# EAGLE board Resistor_Resistor (EAGLE 8.3.0), part 32 of 32
## Placement (x,y rotation side) (continued)
R39180  10K  [0201]  263.09,110.39 0 top
R39181  10K  [0201]  263.09,111 0 top
R39182  10K  [0201]  263.09,111.61 0 top
R39183  10K  [0201]  263.09,112.22 0 top
R39184  10K  [0201]  263.09,112.83 0 top
R39185  10K  [0201]  263.09,113.44 0 top
R39186  10K  [0201]  263.09,114.05 0 top
R39187  10K  [0201]  263.09,114.66 0 top
R39188  10K  [0201]  263.09,115.27 0 top
R39189  10K  [0201]  263.09,115.87 0 top
R39190  10K  [0201]  263.09,116.48 0 top
R39191  10K  [0201]  263.09,117.09 0 top
R39192  10K  [0201]  263.09,117.7 0 top
R39193  10K  [0201]  263.09,118.31 0 top
R39194  10K  [0201]  263.09,118.92 0 top
R39195  10K  [0201]  263.09,119.53 0 top
R39196  10K  [0201]  263.09,120.14 0 top
R39197  10K  [0201]  263.09,120.75 0 top
R39198  10K  [0201]  263.09,121.36 0 top
R39199  10K  [0201]  263.09,121.97 0 top
R39200  10K  [0201]  263.09,122.58 0 top
R39201  10K  [0201]  264.31,1.27 0 top
R39202  10K  [0201]  264.31,1.88 0 top
R39203  10K  [0201]  264.31,2.49 0 top
R39204  10K  [0201]  264.31,3.1 0 top
R39205  10K  [0201]  264.31,3.71 0 top
R39206  10K  [0201]  264.31,4.32 0 top
R39207  10K  [0201]  264.31,4.93 0 top
R39208  10K  [0201]  264.31,5.54 0 top
R39209  10K  [0201]  264.31,6.15 0 top
R39210  10K  [0201]  264.31,6.76 0 top
R39211  10K  [0201]  264.31,7.37 0 top
R39212  10K  [0201]  264.31,7.98 0 top
R39213  10K  [0201]  264.31,8.59 0 top
R39214  10K  [0201]  264.31,9.19 0 top
R39215  10K  [0201]  264.31,9.8 0 top
R39216  10K  [0201]  264.31,10.41 0 top
R39217  10K  [0201]  264.31,11.02 0 top
R39218  10K  [0201]  264.31,11.63 0 top
R39219  10K  [0201]  264.31,12.24 0 top
R39220  10K  [0201]  264.31,12.85 0 top
R39221  10K  [0201]  264.31,13.46 0 top
R39222  10K  [0201]  264.31,14.07 0 top
R39223  10K  [0201]  264.31,14.68 0 top
R39224  10K  [0201]  264.31,15.29 0 top
R39225  10K  [0201]  264.31,15.9 0 top
R39226  10K  [0201]  264.31,16.51 0 top
R39227  10K  [0201]  264.31,17.12 0 top
R39228  10K  [0201]  264.31,17.73 0 top
R39229  10K  [0201]  264.31,18.34 0 top
R39230  10K  [0201]  264.31,18.95 0 top
R39231  10K  [0201]  264.31,19.56 0 top
R39232  10K  [0201]  264.31,20.17 0 top
R39233  10K  [0201]  264.31,20.78 0 top
R39234  10K  [0201]  264.31,21.39 0 top
R39235  10K  [0201]  264.31,22 0 top
R39236  10K  [0201]  264.31,22.61 0 top
R39237  10K  [0201]  264.31,23.22 0 top
R39238  10K  [0201]  264.31,23.83 0 top
R39239  10K  [0201]  264.31,24.43 0 top
R39240  10K  [0201]  264.31,25.04 0 top
R39241  10K  [0201]  264.31,25.65 0 top
R39242  10K  [0201]  264.31,26.26 0 top
R39243  10K  [0201]  264.31,26.87 0 top
R39244  10K  [0201]  264.31,27.48 0 top
R39245  10K  [0201]  264.31,28.09 0 top
R39246  10K  [0201]  264.31,28.7 0 top
R39247  10K  [0201]  264.31,29.31 0 top
R39248  10K  [0201]  264.31,29.92 0 top
R39249  10K  [0201]  264.31,30.53 0 top
R39250  10K  [0201]  264.31,31.14 0 top
R39251  10K  [0201]  264.31,31.75 0 top
R39252  10K  [0201]  264.31,32.36 0 top
R39253  10K  [0201]  264.31,32.97 0 top
R39254  10K  [0201]  264.31,33.58 0 top
R39255  10K  [0201]  264.31,34.19 0 top
R39256  10K  [0201]  264.31,34.8 0 top
R39257  10K  [0201]  264.31,35.41 0 top
R39258  10K  [0201]  264.31,36.02 0 top
R39259  10K  [0201]  264.31,36.63 0 top
R39260  10K  [0201]  264.31,37.24 0 top
R39261  10K  [0201]  264.31,37.85 0 top
R39262  10K  [0201]  264.31,38.46 0 top
R39263  10K  [0201]  264.31,39.07 0 top
R39264  10K  [0201]  264.31,39.67 0 top
R39265  10K  [0201]  264.31,40.28 0 top
R39266  10K  [0201]  264.31,40.89 0 top
R39267  10K  [0201]  264.31,41.5 0 top
R39268  10K  [0201]  264.31,42.11 0 top
R39269  10K  [0201]  264.31,42.72 0 top
R39270  10K  [0201]  264.31,43.33 0 top
R39271  10K  [0201]  264.31,43.94 0 top
R39272  10K  [0201]  264.31,44.55 0 top
R39273  10K  [0201]  264.31,45.16 0 top
R39274  10K  [0201]  264.31,45.77 0 top
R39275  10K  [0201]  264.31,46.38 0 top
R39276  10K  [0201]  264.31,46.99 0 top
R39277  10K  [0201]  264.31,47.6 0 top
R39278  10K  [0201]  264.31,48.21 0 top
R39279  10K  [0201]  264.31,48.82 0 top
R39280  10K  [0201]  264.31,49.43 0 top
R39281  10K  [0201]  264.31,50.04 0 top
R39282  10K  [0201]  264.31,50.65 0 top
R39283  10K  [0201]  264.31,51.26 0 top
R39284  10K  [0201]  264.31,51.87 0 top
R39285  10K  [0201]  264.31,52.48 0 top
R39286  10K  [0201]  264.31,53.09 0 top
R39287  10K  [0201]  264.31,53.7 0 top
R39288  10K  [0201]  264.31,54.31 0 top
R39289  10K  [0201]  264.31,54.91 0 top
R39290  10K  [0201]  264.31,55.52 0 top
R39291  10K  [0201]  264.31,56.13 0 top
R39292  10K  [0201]  264.31,56.74 0 top
R39293  10K  [0201]  264.31,57.35 0 top
R39294  10K  [0201]  264.31,57.96 0 top
R39295  10K  [0201]  264.31,58.57 0 top
R39296  10K  [0201]  264.31,59.18 0 top
R39297  10K  [0201]  264.31,59.79 0 top
R39298  10K  [0201]  264.31,60.4 0 top
R39299  10K  [0201]  264.31,61.01 0 top
R39300  10K  [0201]  264.31,61.62 0 top
R39301  10K  [0201]  264.31,62.23 0 top
R39302  10K  [0201]  264.31,62.84 0 top
R39303  10K  [0201]  264.31,63.45 0 top
R39304  10K  [0201]  264.31,64.06 0 top
R39305  10K  [0201]  264.31,64.67 0 top
R39306  10K  [0201]  264.31,65.28 0 top
R39307  10K  [0201]  264.31,65.89 0 top
R39308  10K  [0201]  264.31,66.5 0 top
R39309  10K  [0201]  264.31,67.11 0 top
R39310  10K  [0201]  264.31,67.72 0 top
R39311  10K  [0201]  264.31,68.33 0 top
R39312  10K  [0201]  264.31,68.94 0 top
R39313  10K  [0201]  264.31,69.55 0 top
R39314  10K  [0201]  264.31,70.15 0 top
R39315  10K  [0201]  264.31,70.76 0 top
R39316  10K  [0201]  264.31,71.37 0 top
R39317  10K  [0201]  264.31,71.98 0 top
R39318  10K  [0201]  264.31,72.59 0 top
R39319  10K  [0201]  264.31,73.2 0 top
R39320  10K  [0201]  264.31,73.81 0 top
R39321  10K  [0201]  264.31,74.42 0 top
R39322  10K  [0201]  264.31,75.03 0 top
R39323  10K  [0201]  264.31,75.64 0 top
R39324  10K  [0201]  264.31,76.25 0 top
R39325  10K  [0201]  264.31,76.86 0 top
R39326  10K  [0201]  264.31,77.47 0 top
R39327  10K  [0201]  264.31,78.08 0 top
R39328  10K  [0201]  264.31,78.69 0 top
R39329  10K  [0201]  264.31,79.3 0 top
R39330  10K  [0201]  264.31,79.91 0 top
R39331  10K  [0201]  264.31,80.52 0 top
R39332  10K  [0201]  264.31,81.13 0 top
R39333  10K  [0201]  264.31,81.74 0 top
R39334  10K  [0201]  264.31,82.35 0 top
R39335  10K  [0201]  264.31,82.96 0 top
R39336  10K  [0201]  264.31,83.57 0 top
R39337  10K  [0201]  264.31,84.18 0 top
R39338  10K  [0201]  264.31,84.79 0 top
R39339  10K  [0201]  264.31,85.39 0 top
R39340  10K  [0201]  264.31,86 0 top
R39341  10K  [0201]  264.31,86.61 0 top
R39342  10K  [0201]  264.31,87.22 0 top
R39343  10K  [0201]  264.31,87.83 0 top
R39344  10K  [0201]  264.31,88.44 0 top
R39345  10K  [0201]  264.31,89.05 0 top
R39346  10K  [0201]  264.31,89.66 0 top
R39347  10K  [0201]  264.31,90.27 0 top
R39348  10K  [0201]  264.31,90.88 0 top
R39349  10K  [0201]  264.31,91.49 0 top
R39350  10K  [0201]  264.31,92.1 0 top
R39351  10K  [0201]  264.31,92.71 0 top
R39352  10K  [0201]  264.31,93.32 0 top
R39353  10K  [0201]  264.31,93.93 0 top
R39354  10K  [0201]  264.31,94.54 0 top
R39355  10K  [0201]  264.31,95.15 0 top
R39356  10K  [0201]  264.31,95.76 0 top
R39357  10K  [0201]  264.31,96.37 0 top
R39358  10K  [0201]  264.31,96.98 0 top
R39359  10K  [0201]  264.31,97.59 0 top
R39360  10K  [0201]  264.31,98.2 0 top
R39361  10K  [0201]  264.31,98.81 0 top
R39362  10K  [0201]  264.31,99.42 0 top
R39363  10K  [0201]  264.31,100.03 0 top
R39364  10K  [0201]  264.31,100.63 0 top
R39365  10K  [0201]  264.31,101.24 0 top
R39366  10K  [0201]  264.31,101.85 0 top
R39367  10K  [0201]  264.31,102.46 0 top
R39368  10K  [0201]  264.31,103.07 0 top
R39369  10K  [0201]  264.31,103.68 0 top
R39370  10K  [0201]  264.31,104.29 0 top
R39371  10K  [0201]  264.31,104.9 0 top
R39372  10K  [0201]  264.31,105.51 0 top
R39373  10K  [0201]  264.31,106.12 0 top
R39374  10K  [0201]  264.31,106.73 0 top
R39375  10K  [0201]  264.31,107.34 0 top
R39376  10K  [0201]  264.31,107.95 0 top
R39377  10K  [0201]  264.31,108.56 0 top
R39378  10K  [0201]  264.31,109.17 0 top
R39379  10K  [0201]  264.31,109.78 0 top
R39380  10K  [0201]  264.31,110.39 0 top
R39381  10K  [0201]  264.31,111 0 top
R39382  10K  [0201]  264.31,111.61 0 top
R39383  10K  [0201]  264.31,112.22 0 top
R39384  10K  [0201]  264.31,112.83 0 top
R39385  10K  [0201]  264.31,113.44 0 top
R39386  10K  [0201]  264.31,114.05 0 top
R39387  10K  [0201]  264.31,114.66 0 top
R39388  10K  [0201]  264.31,115.27 0 top
R39389  10K  [0201]  264.31,115.87 0 top
R39390  10K  [0201]  264.31,116.48 0 top
R39391  10K  [0201]  264.31,117.09 0 top
R39392  10K  [0201]  264.31,117.7 0 top
R39393  10K  [0201]  264.31,118.31 0 top
R39394  10K  [0201]  264.31,118.92 0 top
R39395  10K  [0201]  264.31,119.53 0 top
R39396  10K  [0201]  264.31,120.14 0 top
R39397  10K  [0201]  264.31,120.75 0 top
R39398  10K  [0201]  264.31,121.36 0 top
R39399  10K  [0201]  264.31,121.97 0 top
R39400  10K  [0201]  264.31,122.58 0 top
R39401  10K  [0201]  265.53,1.27 0 top
R39402  10K  [0201]  265.53,1.88 0 top
R39403  10K  [0201]  265.53,2.49 0 top
R39404  10K  [0201]  265.53,3.1 0 top
R39405  10K  [0201]  265.53,3.71 0 top
R39406  10K  [0201]  265.53,4.32 0 top
R39407  10K  [0201]  265.53,4.93 0 top
R39408  10K  [0201]  265.53,5.54 0 top
R39409  10K  [0201]  265.53,6.15 0 top
R39410  10K  [0201]  265.53,6.76 0 top
R39411  10K  [0201]  265.53,7.37 0 top
R39412  10K  [0201]  265.53,7.98 0 top
R39413  10K  [0201]  265.53,8.59 0 top
R39414  10K  [0201]  265.53,9.19 0 top
R39415  10K  [0201]  265.53,9.8 0 top
R39416  10K  [0201]  265.53,10.41 0 top
R39417  10K  [0201]  265.53,11.02 0 top
R39418  10K  [0201]  265.53,11.63 0 top
R39419  10K  [0201]  265.53,12.24 0 top
R39420  10K  [0201]  265.53,12.85 0 top
R39421  10K  [0201]  265.53,13.46 0 top
R39422  10K  [0201]  265.53,14.07 0 top
R39423  10K  [0201]  265.53,14.68 0 top
R39424  10K  [0201]  265.53,15.29 0 top
R39425  10K  [0201]  265.53,15.9 0 top
R39426  10K  [0201]  265.53,16.51 0 top
R39427  10K  [0201]  265.53,17.12 0 top
R39428  10K  [0201]  265.53,17.73 0 top
R39429  10K  [0201]  265.53,18.34 0 top
R39430  10K  [0201]  265.53,18.95 0 top
R39431  10K  [0201]  265.53,19.56 0 top
R39432  10K  [0201]  265.53,20.17 0 top
R39433  10K  [0201]  265.53,20.78 0 top
R39434  10K  [0201]  265.53,21.39 0 top
R39435  10K  [0201]  265.53,22 0 top
R39436  10K  [0201]  265.53,22.61 0 top
R39437  10K  [0201]  265.53,23.22 0 top
R39438  10K  [0201]  265.53,23.83 0 top
R39439  10K  [0201]  265.53,24.43 0 top
R39440  10K  [0201]  265.53,25.04 0 top
R39441  10K  [0201]  265.53,25.65 0 top
R39442  10K  [0201]  265.53,26.26 0 top
R39443  10K  [0201]  265.53,26.87 0 top
R39444  10K  [0201]  265.53,27.48 0 top
R39445  10K  [0201]  265.53,28.09 0 top
R39446  10K  [0201]  265.53,28.7 0 top
R39447  10K  [0201]  265.53,29.31 0 top
R39448  10K  [0201]  265.53,29.92 0 top
R39449  10K  [0201]  265.53,30.53 0 top
R39450  10K  [0201]  265.53,31.14 0 top
R39451  10K  [0201]  265.53,31.75 0 top
R39452  10K  [0201]  265.53,32.36 0 top
R39453  10K  [0201]  265.53,32.97 0 top
R39454  10K  [0201]  265.53,33.58 0 top
R39455  10K  [0201]  265.53,34.19 0 top
R39456  10K  [0201]  265.53,34.8 0 top
R39457  10K  [0201]  265.53,35.41 0 top
R39458  10K  [0201]  265.53,36.02 0 top
R39459  10K  [0201]  265.53,36.63 0 top
R39460  10K  [0201]  265.53,37.24 0 top
R39461  10K  [0201]  265.53,37.85 0 top
R39462  10K  [0201]  265.53,38.46 0 top
R39463  10K  [0201]  265.53,39.07 0 top
R39464  10K  [0201]  265.53,39.67 0 top
R39465  10K  [0201]  265.53,40.28 0 top
R39466  10K  [0201]  265.53,40.89 0 top
R39467  10K  [0201]  265.53,41.5 0 top
R39468  10K  [0201]  265.53,42.11 0 top
R39469  10K  [0201]  265.53,42.72 0 top
R39470  10K  [0201]  265.53,43.33 0 top
R39471  10K  [0201]  265.53,43.94 0 top
R39472  10K  [0201]  265.53,44.55 0 top
R39473  10K  [0201]  265.53,45.16 0 top
R39474  10K  [0201]  265.53,45.77 0 top
R39475  10K  [0201]  265.53,46.38 0 top
R39476  10K  [0201]  265.53,46.99 0 top
R39477  10K  [0201]  265.53,47.6 0 top
R39478  10K  [0201]  265.53,48.21 0 top
R39479  10K  [0201]  265.53,48.82 0 top
R39480  10K  [0201]  265.53,49.43 0 top
R39481  10K  [0201]  265.53,50.04 0 top
R39482  10K  [0201]  265.53,50.65 0 top
R39483  10K  [0201]  265.53,51.26 0 top
R39484  10K  [0201]  265.53,51.87 0 top
R39485  10K  [0201]  265.53,52.48 0 top
R39486  10K  [0201]  265.53,53.09 0 top
R39487  10K  [0201]  265.53,53.7 0 top
R39488  10K  [0201]  265.53,54.31 0 top
R39489  10K  [0201]  265.53,54.91 0 top
R39490  10K  [0201]  265.53,55.52 0 top
R39491  10K  [0201]  265.53,56.13 0 top
R39492  10K  [0201]  265.53,56.74 0 top
R39493  10K  [0201]  265.53,57.35 0 top
R39494  10K  [0201]  265.53,57.96 0 top
R39495  10K  [0201]  265.53,58.57 0 top
R39496  10K  [0201]  265.53,59.18 0 top
R39497  10K  [0201]  265.53,59.79 0 top
R39498  10K  [0201]  265.53,60.4 0 top
R39499  10K  [0201]  265.53,61.01 0 top
R39500  10K  [0201]  265.53,61.62 0 top
R39501  10K  [0201]  265.53,62.23 0 top
R39502  10K  [0201]  265.53,62.84 0 top
R39503  10K  [0201]  265.53,63.45 0 top
R39504  10K  [0201]  265.53,64.06 0 top
R39505  10K  [0201]  265.53,64.67 0 top
R39506  10K  [0201]  265.53,65.28 0 top
R39507  10K  [0201]  265.53,65.89 0 top
R39508  10K  [0201]  265.53,66.5 0 top
R39509  10K  [0201]  265.53,67.11 0 top
R39510  10K  [0201]  265.53,67.72 0 top
R39511  10K  [0201]  265.53,68.33 0 top
R39512  10K  [0201]  265.53,68.94 0 top
R39513  10K  [0201]  265.53,69.55 0 top
R39514  10K  [0201]  265.53,70.15 0 top
R39515  10K  [0201]  265.53,70.76 0 top
R39516  10K  [0201]  265.53,71.37 0 top
R39517  10K  [0201]  265.53,71.98 0 top
R39518  10K  [0201]  265.53,72.59 0 top
R39519  10K  [0201]  265.53,73.2 0 top
R39520  10K  [0201]  265.53,73.81 0 top
R39521  10K  [0201]  265.53,74.42 0 top
R39522  10K  [0201]  265.53,75.03 0 top
R39523  10K  [0201]  265.53,75.64 0 top
R39524  10K  [0201]  265.53,76.25 0 top
R39525  10K  [0201]  265.53,76.86 0 top
R39526  10K  [0201]  265.53,77.47 0 top
R39527  10K  [0201]  265.53,78.08 0 top
R39528  10K  [0201]  265.53,78.69 0 top
R39529  10K  [0201]  265.53,79.3 0 top
R39530  10K  [0201]  265.53,79.91 0 top
R39531  10K  [0201]  265.53,80.52 0 top
R39532  10K  [0201]  265.53,81.13 0 top
R39533  10K  [0201]  265.53,81.74 0 top
R39534  10K  [0201]  265.53,82.35 0 top
R39535  10K  [0201]  265.53,82.96 0 top
R39536  10K  [0201]  265.53,83.57 0 top
R39537  10K  [0201]  265.53,84.18 0 top
R39538  10K  [0201]  265.53,84.79 0 top
R39539  10K  [0201]  265.53,85.39 0 top
R39540  10K  [0201]  265.53,86 0 top
R39541  10K  [0201]  265.53,86.61 0 top
R39542  10K  [0201]  265.53,87.22 0 top
R39543  10K  [0201]  265.53,87.83 0 top
R39544  10K  [0201]  265.53,88.44 0 top
R39545  10K  [0201]  265.53,89.05 0 top
R39546  10K  [0201]  265.53,89.66 0 top
R39547  10K  [0201]  265.53,90.27 0 top
R39548  10K  [0201]  265.53,90.88 0 top
R39549  10K  [0201]  265.53,91.49 0 top
R39550  10K  [0201]  265.53,92.1 0 top
R39551  10K  [0201]  265.53,92.71 0 top
R39552  10K  [0201]  265.53,93.32 0 top
R39553  10K  [0201]  265.53,93.93 0 top
R39554  10K  [0201]  265.53,94.54 0 top
R39555  10K  [0201]  265.53,95.15 0 top
R39556  10K  [0201]  265.53,95.76 0 top
R39557  10K  [0201]  265.53,96.37 0 top
R39558  10K  [0201]  265.53,96.98 0 top
R39559  10K  [0201]  265.53,97.59 0 top
R39560  10K  [0201]  265.53,98.2 0 top
R39561  10K  [0201]  265.53,98.81 0 top
R39562  10K  [0201]  265.53,99.42 0 top
R39563  10K  [0201]  265.53,100.03 0 top
R39564  10K  [0201]  265.53,100.63 0 top
R39565  10K  [0201]  265.53,101.24 0 top
R39566  10K  [0201]  265.53,101.85 0 top
R39567  10K  [0201]  265.53,102.46 0 top
R39568  10K  [0201]  265.53,103.07 0 top
R39569  10K  [0201]  265.53,103.68 0 top
R39570  10K  [0201]  265.53,104.29 0 top
R39571  10K  [0201]  265.53,104.9 0 top
R39572  10K  [0201]  265.53,105.51 0 top
R39573  10K  [0201]  265.53,106.12 0 top
R39574  10K  [0201]  265.53,106.73 0 top
R39575  10K  [0201]  265.53,107.34 0 top
R39576  10K  [0201]  265.53,107.95 0 top
R39577  10K  [0201]  265.53,108.56 0 top
R39578  10K  [0201]  265.53,109.17 0 top
R39579  10K  [0201]  265.53,109.78 0 top
R39580  10K  [0201]  265.53,110.39 0 top
R39581  10K  [0201]  265.53,111 0 top
R39582  10K  [0201]  265.53,111.61 0 top
R39583  10K  [0201]  265.53,112.22 0 top
R39584  10K  [0201]  265.53,112.83 0 top
R39585  10K  [0201]  265.53,113.44 0 top
R39586  10K  [0201]  265.53,114.05 0 top
R39587  10K  [0201]  265.53,114.66 0 top
R39588  10K  [0201]  265.53,115.27 0 top
R39589  10K  [0201]  265.53,115.87 0 top
R39590  10K  [0201]  265.53,116.48 0 top
R39591  10K  [0201]  265.53,117.09 0 top
R39592  10K  [0201]  265.53,117.7 0 top
R39593  10K  [0201]  265.53,118.31 0 top
R39594  10K  [0201]  265.53,118.92 0 top
R39595  10K  [0201]  265.53,119.53 0 top
R39596  10K  [0201]  265.53,120.14 0 top
R39597  10K  [0201]  265.53,120.75 0 top
R39598  10K  [0201]  265.53,121.36 0 top
R39599  10K  [0201]  265.53,121.97 0 top
R39600  10K  [0201]  265.53,122.58 0 top
R39601  10K  [0201]  266.75,1.27 0 top
R39602  10K  [0201]  266.75,1.88 0 top
R39603  10K  [0201]  266.75,2.49 0 top
R39604  10K  [0201]  266.75,3.1 0 top
R39605  10K  [0201]  266.75,3.71 0 top
R39606  10K  [0201]  266.75,4.32 0 top
R39607  10K  [0201]  266.75,4.93 0 top
R39608  10K  [0201]  266.75,5.54 0 top
R39609  10K  [0201]  266.75,6.15 0 top
R39610  10K  [0201]  266.75,6.76 0 top
R39611  10K  [0201]  266.75,7.37 0 top
R39612  10K  [0201]  266.75,7.98 0 top
R39613  10K  [0201]  266.75,8.59 0 top
R39614  10K  [0201]  266.75,9.19 0 top
R39615  10K  [0201]  266.75,9.8 0 top
R39616  10K  [0201]  266.75,10.41 0 top
R39617  10K  [0201]  266.75,11.02 0 top
R39618  10K  [0201]  266.75,11.63 0 top
R39619  10K  [0201]  266.75,12.24 0 top
R39620  10K  [0201]  266.75,12.85 0 top
R39621  10K  [0201]  266.75,13.46 0 top
R39622  10K  [0201]  266.75,14.07 0 top
R39623  10K  [0201]  266.75,14.68 0 top
R39624  10K  [0201]  266.75,15.29 0 top
R39625  10K  [0201]  266.75,15.9 0 top
R39626  10K  [0201]  266.75,16.51 0 top
R39627  10K  [0201]  266.75,17.12 0 top
R39628  10K  [0201]  266.75,17.73 0 top
R39629  10K  [0201]  266.75,18.34 0 top
R39630  10K  [0201]  266.75,18.95 0 top
R39631  10K  [0201]  266.75,19.56 0 top
R39632  10K  [0201]  266.75,20.17 0 top
R39633  10K  [0201]  266.75,20.78 0 top
R39634  10K  [0201]  266.75,21.39 0 top
R39635  10K  [0201]  266.75,22 0 top
R39636  10K  [0201]  266.75,22.61 0 top
R39637  10K  [0201]  266.75,23.22 0 top
R39638  10K  [0201]  266.75,23.83 0 top
R39639  10K  [0201]  266.75,24.43 0 top
R39640  10K  [0201]  266.75,25.04 0 top
R39641  10K  [0201]  266.75,25.65 0 top
R39642  10K  [0201]  266.75,26.26 0 top
R39643  10K  [0201]  266.75,26.87 0 top
R39644  10K  [0201]  266.75,27.48 0 top
R39645  10K  [0201]  266.75,28.09 0 top
R39646  10K  [0201]  266.75,28.7 0 top
R39647  10K  [0201]  266.75,29.31 0 top
R39648  10K  [0201]  266.75,29.92 0 top
R39649  10K  [0201]  266.75,30.53 0 top
R39650  10K  [0201]  266.75,31.14 0 top
R39651  10K  [0201]  266.75,31.75 0 top
R39652  10K  [0201]  266.75,32.36 0 top
R39653  10K  [0201]  266.75,32.97 0 top
R39654  10K  [0201]  266.75,33.58 0 top
R39655  10K  [0201]  266.75,34.19 0 top
R39656  10K  [0201]  266.75,34.8 0 top
R39657  10K  [0201]  266.75,35.41 0 top
R39658  10K  [0201]  266.75,36.02 0 top
R39659  10K  [0201]  266.75,36.63 0 top
R39660  10K  [0201]  266.75,37.24 0 top
R39661  10K  [0201]  266.75,37.85 0 top
R39662  10K  [0201]  266.75,38.46 0 top
R39663  10K  [0201]  266.75,39.07 0 top
R39664  10K  [0201]  266.75,39.67 0 top
R39665  10K  [0201]  266.75,40.28 0 top
R39666  10K  [0201]  266.75,40.89 0 top
R39667  10K  [0201]  266.75,41.5 0 top
R39668  10K  [0201]  266.75,42.11 0 top
R39669  10K  [0201]  266.75,42.72 0 top
R39670  10K  [0201]  266.75,43.33 0 top
R39671  10K  [0201]  266.75,43.94 0 top
R39672  10K  [0201]  266.75,44.55 0 top
R39673  10K  [0201]  266.75,45.16 0 top
R39674  10K  [0201]  266.75,45.77 0 top
R39675  10K  [0201]  266.75,46.38 0 top
R39676  10K  [0201]  266.75,46.99 0 top
R39677  10K  [0201]  266.75,47.6 0 top
R39678  10K  [0201]  266.75,48.21 0 top
R39679  10K  [0201]  266.75,48.82 0 top
R39680  10K  [0201]  266.75,49.43 0 top
R39681  10K  [0201]  266.75,50.04 0 top
R39682  10K  [0201]  266.75,50.65 0 top
R39683  10K  [0201]  266.75,51.26 0 top
R39684  10K  [0201]  266.75,51.87 0 top
R39685  10K  [0201]  266.75,52.48 0 top
R39686  10K  [0201]  266.75,53.09 0 top
R39687  10K  [0201]  266.75,53.7 0 top
R39688  10K  [0201]  266.75,54.31 0 top
R39689  10K  [0201]  266.75,54.91 0 top
R39690  10K  [0201]  266.75,55.52 0 top
R39691  10K  [0201]  266.75,56.13 0 top
R39692  10K  [0201]  266.75,56.74 0 top
R39693  10K  [0201]  266.75,57.35 0 top
R39694  10K  [0201]  266.75,57.96 0 top
R39695  10K  [0201]  266.75,58.57 0 top
R39696  10K  [0201]  266.75,59.18 0 top
R39697  10K  [0201]  266.75,59.79 0 top
R39698  10K  [0201]  266.75,60.4 0 top
R39699  10K  [0201]  266.75,61.01 0 top
R39700  10K  [0201]  266.75,61.62 0 top
R39701  10K  [0201]  266.75,62.23 0 top
R39702  10K  [0201]  266.75,62.84 0 top
R39703  10K  [0201]  266.75,63.45 0 top
R39704  10K  [0201]  266.75,64.06 0 top
R39705  10K  [0201]  266.75,64.67 0 top
R39706  10K  [0201]  266.75,65.28 0 top
R39707  10K  [0201]  266.75,65.89 0 top
R39708  10K  [0201]  266.75,66.5 0 top
R39709  10K  [0201]  266.75,67.11 0 top
R39710  10K  [0201]  266.75,67.72 0 top
R39711  10K  [0201]  266.75,68.33 0 top
R39712  10K  [0201]  266.75,68.94 0 top
R39713  10K  [0201]  266.75,69.55 0 top
R39714  10K  [0201]  266.75,70.15 0 top
R39715  10K  [0201]  266.75,70.76 0 top
R39716  10K  [0201]  266.75,71.37 0 top
R39717  10K  [0201]  266.75,71.98 0 top
R39718  10K  [0201]  266.75,72.59 0 top
R39719  10K  [0201]  266.75,73.2 0 top
R39720  10K  [0201]  266.75,73.81 0 top
R39721  10K  [0201]  266.75,74.42 0 top
R39722  10K  [0201]  266.75,75.03 0 top
R39723  10K  [0201]  266.75,75.64 0 top
R39724  10K  [0201]  266.75,76.25 0 top
R39725  10K  [0201]  266.75,76.86 0 top
R39726  10K  [0201]  266.75,77.47 0 top
R39727  10K  [0201]  266.75,78.08 0 top
R39728  10K  [0201]  266.75,78.69 0 top
R39729  10K  [0201]  266.75,79.3 0 top
R39730  10K  [0201]  266.75,79.91 0 top
R39731  10K  [0201]  266.75,80.52 0 top
R39732  10K  [0201]  266.75,81.13 0 top
R39733  10K  [0201]  266.75,81.74 0 top
R39734  10K  [0201]  266.75,82.35 0 top
R39735  10K  [0201]  266.75,82.96 0 top
R39736  10K  [0201]  266.75,83.57 0 top
R39737  10K  [0201]  266.75,84.18 0 top
R39738  10K  [0201]  266.75,84.79 0 top
R39739  10K  [0201]  266.75,85.39 0 top
R39740  10K  [0201]  266.75,86 0 top
R39741  10K  [0201]  266.75,86.61 0 top
R39742  10K  [0201]  266.75,87.22 0 top
R39743  10K  [0201]  266.75,87.83 0 top
R39744  10K  [0201]  266.75,88.44 0 top
R39745  10K  [0201]  266.75,89.05 0 top
R39746  10K  [0201]  266.75,89.66 0 top
R39747  10K  [0201]  266.75,90.27 0 top
R39748  10K  [0201]  266.75,90.88 0 top
R39749  10K  [0201]  266.75,91.49 0 top
R39750  10K  [0201]  266.75,92.1 0 top
R39751  10K  [0201]  266.75,92.71 0 top
R39752  10K  [0201]  266.75,93.32 0 top
R39753  10K  [0201]  266.75,93.93 0 top
R39754  10K  [0201]  266.75,94.54 0 top
R39755  10K  [0201]  266.75,95.15 0 top
R39756  10K  [0201]  266.75,95.76 0 top
R39757  10K  [0201]  266.75,96.37 0 top
R39758  10K  [0201]  266.75,96.98 0 top
R39759  10K  [0201]  266.75,97.59 0 top
R39760  10K  [0201]  266.75,98.2 0 top
R39761  10K  [0201]  266.75,98.81 0 top
R39762  10K  [0201]  266.75,99.42 0 top
R39763  10K  [0201]  266.75,100.03 0 top
R39764  10K  [0201]  266.75,100.63 0 top
R39765  10K  [0201]  266.75,101.24 0 top
R39766  10K  [0201]  266.75,101.85 0 top
R39767  10K  [0201]  266.75,102.46 0 top
R39768  10K  [0201]  266.75,103.07 0 top
R39769  10K  [0201]  266.75,103.68 0 top
R39770  10K  [0201]  266.75,104.29 0 top
R39771  10K  [0201]  266.75,104.9 0 top
R39772  10K  [0201]  266.75,105.51 0 top
R39773  10K  [0201]  266.75,106.12 0 top
R39774  10K  [0201]  266.75,106.73 0 top
R39775  10K  [0201]  266.75,107.34 0 top
R39776  10K  [0201]  266.75,107.95 0 top
R39777  10K  [0201]  266.75,108.56 0 top
R39778  10K  [0201]  266.75,109.17 0 top
R39779  10K  [0201]  266.75,109.78 0 top
R39780  10K  [0201]  266.75,110.39 0 top
R39781  10K  [0201]  266.75,111 0 top
R39782  10K  [0201]  266.75,111.61 0 top
R39783  10K  [0201]  266.75,112.22 0 top
R39784  10K  [0201]  266.75,112.83 0 top
R39785  10K  [0201]  266.75,113.44 0 top
R39786  10K  [0201]  266.75,114.05 0 top
R39787  10K  [0201]  266.75,114.66 0 top
R39788  10K  [0201]  266.75,115.27 0 top
R39789  10K  [0201]  266.75,115.87 0 top
R39790  10K  [0201]  266.75,116.48 0 top
R39791  10K  [0201]  266.75,117.09 0 top
R39792  10K  [0201]  266.75,117.7 0 top
R39793  10K  [0201]  266.75,118.31 0 top
R39794  10K  [0201]  266.75,118.92 0 top
R39795  10K  [0201]  266.75,119.53 0 top
R39796  10K  [0201]  266.75,120.14 0 top
R39797  10K  [0201]  266.75,120.75 0 top
R39798  10K  [0201]  266.75,121.36 0 top
R39799  10K  [0201]  266.75,121.97 0 top
R39800  10K  [0201]  266.75,122.58 0 top
R39801  10K  [0201]  267.97,1.27 0 top
R39802  10K  [0201]  267.97,1.88 0 top
R39803  10K  [0201]  267.97,2.49 0 top
R39804  10K  [0201]  267.97,3.1 0 top
R39805  10K  [0201]  267.97,3.71 0 top
R39806  10K  [0201]  267.97,4.32 0 top
R39807  10K  [0201]  267.97,4.93 0 top
R39808  10K  [0201]  267.97,5.54 0 top
R39809  10K  [0201]  267.97,6.15 0 top
R39810  10K  [0201]  267.97,6.76 0 top
R39811  10K  [0201]  267.97,7.37 0 top
R39812  10K  [0201]  267.97,7.98 0 top
R39813  10K  [0201]  267.97,8.59 0 top
R39814  10K  [0201]  267.97,9.19 0 top
R39815  10K  [0201]  267.97,9.8 0 top
R39816  10K  [0201]  267.97,10.41 0 top
R39817  10K  [0201]  267.97,11.02 0 top
R39818  10K  [0201]  267.97,11.63 0 top
R39819  10K  [0201]  267.97,12.24 0 top
R39820  10K  [0201]  267.97,12.85 0 top
R39821  10K  [0201]  267.97,13.46 0 top
R39822  10K  [0201]  267.97,14.07 0 top
R39823  10K  [0201]  267.97,14.68 0 top
R39824  10K  [0201]  267.97,15.29 0 top
R39825  10K  [0201]  267.97,15.9 0 top
R39826  10K  [0201]  267.97,16.51 0 top
R39827  10K  [0201]  267.97,17.12 0 top
R39828  10K  [0201]  267.97,17.73 0 top
R39829  10K  [0201]  267.97,18.34 0 top
R39830  10K  [0201]  267.97,18.95 0 top
R39831  10K  [0201]  267.97,19.56 0 top
R39832  10K  [0201]  267.97,20.17 0 top
R39833  10K  [0201]  267.97,20.78 0 top
R39834  10K  [0201]  267.97,21.39 0 top
R39835  10K  [0201]  267.97,22 0 top
R39836  10K  [0201]  267.97,22.61 0 top
R39837  10K  [0201]  267.97,23.22 0 top
R39838  10K  [0201]  267.97,23.83 0 top
R39839  10K  [0201]  267.97,24.43 0 top
R39840  10K  [0201]  267.97,25.04 0 top
R39841  10K  [0201]  267.97,25.65 0 top
R39842  10K  [0201]  267.97,26.26 0 top
R39843  10K  [0201]  267.97,26.87 0 top
R39844  10K  [0201]  267.97,27.48 0 top
R39845  10K  [0201]  267.97,28.09 0 top
R39846  10K  [0201]  267.97,28.7 0 top
R39847  10K  [0201]  267.97,29.31 0 top
R39848  10K  [0201]  267.97,29.92 0 top
R39849  10K  [0201]  267.97,30.53 0 top
R39850  10K  [0201]  267.97,31.14 0 top
R39851  10K  [0201]  267.97,31.75 0 top
R39852  10K  [0201]  267.97,32.36 0 top
R39853  10K  [0201]  267.97,32.97 0 top
R39854  10K  [0201]  267.97,33.58 0 top
R39855  10K  [0201]  267.97,34.19 0 top
R39856  10K  [0201]  267.97,34.8 0 top
R39857  10K  [0201]  267.97,35.41 0 top
R39858  10K  [0201]  267.97,36.02 0 top
R39859  10K  [0201]  267.97,36.63 0 top
R39860  10K  [0201]  267.97,37.24 0 top
R39861  10K  [0201]  267.97,37.85 0 top
R39862  10K  [0201]  267.97,38.46 0 top
R39863  10K  [0201]  267.97,39.07 0 top
R39864  10K  [0201]  267.97,39.67 0 top
R39865  10K  [0201]  267.97,40.28 0 top
R39866  10K  [0201]  267.97,40.89 0 top
R39867  10K  [0201]  267.97,41.5 0 top
R39868  10K  [0201]  267.97,42.11 0 top
R39869  10K  [0201]  267.97,42.72 0 top
R39870  10K  [0201]  267.97,43.33 0 top
R39871  10K  [0201]  267.97,43.94 0 top
R39872  10K  [0201]  267.97,44.55 0 top
R39873  10K  [0201]  267.97,45.16 0 top
R39874  10K  [0201]  267.97,45.77 0 top
R39875  10K  [0201]  267.97,46.38 0 top
R39876  10K  [0201]  267.97,46.99 0 top
R39877  10K  [0201]  267.97,47.6 0 top
R39878  10K  [0201]  267.97,48.21 0 top
R39879  10K  [0201]  267.97,48.82 0 top
R39880  10K  [0201]  267.97,49.43 0 top
R39881  10K  [0201]  267.97,50.04 0 top
R39882  10K  [0201]  267.97,50.65 0 top
R39883  10K  [0201]  267.97,51.26 0 top
R39884  10K  [0201]  267.97,51.87 0 top
R39885  10K  [0201]  267.97,52.48 0 top
R39886  10K  [0201]  267.97,53.09 0 top
R39887  10K  [0201]  267.97,53.7 0 top
R39888  10K  [0201]  267.97,54.31 0 top
R39889  10K  [0201]  267.97,54.91 0 top
R39890  10K  [0201]  267.97,55.52 0 top
R39891  10K  [0201]  267.97,56.13 0 top
R39892  10K  [0201]  267.97,56.74 0 top
R39893  10K  [0201]  267.97,57.35 0 top
R39894  10K  [0201]  267.97,57.96 0 top
R39895  10K  [0201]  267.97,58.57 0 top
R39896  10K  [0201]  267.97,59.18 0 top
R39897  10K  [0201]  267.97,59.79 0 top
R39898  10K  [0201]  267.97,60.4 0 top
R39899  10K  [0201]  267.97,61.01 0 top
R39900  10K  [0201]  267.97,61.62 0 top
R39901  10K  [0201]  267.97,62.23 0 top
R39902  10K  [0201]  267.97,62.84 0 top
R39903  10K  [0201]  267.97,63.45 0 top
R39904  10K  [0201]  267.97,64.06 0 top
R39905  10K  [0201]  267.97,64.67 0 top
R39906  10K  [0201]  267.97,65.28 0 top
R39907  10K  [0201]  267.97,65.89 0 top
R39908  10K  [0201]  267.97,66.5 0 top
R39909  10K  [0201]  267.97,67.11 0 top
R39910  10K  [0201]  267.97,67.72 0 top
R39911  10K  [0201]  267.97,68.33 0 top
R39912  10K  [0201]  267.97,68.94 0 top
R39913  10K  [0201]  267.97,69.55 0 top
R39914  10K  [0201]  267.97,70.15 0 top
R39915  10K  [0201]  267.97,70.76 0 top
R39916  10K  [0201]  267.97,71.37 0 top
R39917  10K  [0201]  267.97,71.98 0 top
R39918  10K  [0201]  267.97,72.59 0 top
R39919  10K  [0201]  267.97,73.2 0 top
R39920  10K  [0201]  267.97,73.81 0 top
R39921  10K  [0201]  267.97,74.42 0 top
R39922  10K  [0201]  267.97,75.03 0 top
R39923  10K  [0201]  267.97,75.64 0 top
R39924  10K  [0201]  267.97,76.25 0 top
R39925  10K  [0201]  267.97,76.86 0 top
R39926  10K  [0201]  267.97,77.47 0 top
R39927  10K  [0201]  267.97,78.08 0 top
R39928  10K  [0201]  267.97,78.69 0 top
R39929  10K  [0201]  267.97,79.3 0 top
R39930  10K  [0201]  267.97,79.91 0 top
R39931  10K  [0201]  267.97,80.52 0 top
R39932  10K  [0201]  267.97,81.13 0 top
R39933  10K  [0201]  267.97,81.74 0 top
R39934  10K  [0201]  267.97,82.35 0 top
R39935  10K  [0201]  267.97,82.96 0 top
R39936  10K  [0201]  267.97,83.57 0 top
R39937  10K  [0201]  267.97,84.18 0 top
R39938  10K  [0201]  267.97,84.79 0 top
R39939  10K  [0201]  267.97,85.39 0 top
R39940  10K  [0201]  267.97,86 0 top
R39941  10K  [0201]  267.97,86.61 0 top
R39942  10K  [0201]  267.97,87.22 0 top
R39943  10K  [0201]  267.97,87.83 0 top
R39944  10K  [0201]  267.97,88.44 0 top
R39945  10K  [0201]  267.97,89.05 0 top
R39946  10K  [0201]  267.97,89.66 0 top
R39947  10K  [0201]  267.97,90.27 0 top
R39948  10K  [0201]  267.97,90.88 0 top
R39949  10K  [0201]  267.97,91.49 0 top
R39950  10K  [0201]  267.97,92.1 0 top
R39951  10K  [0201]  267.97,92.71 0 top
R39952  10K  [0201]  267.97,93.32 0 top
R39953  10K  [0201]  267.97,93.93 0 top
R39954  10K  [0201]  267.97,94.54 0 top
R39955  10K  [0201]  267.97,95.15 0 top
R39956  10K  [0201]  267.97,95.76 0 top
R39957  10K  [0201]  267.97,96.37 0 top
R39958  10K  [0201]  267.97,96.98 0 top
R39959  10K  [0201]  267.97,97.59 0 top
R39960  10K  [0201]  267.97,98.2 0 top
R39961  10K  [0201]  267.97,98.81 0 top
R39962  10K  [0201]  267.97,99.42 0 top
R39963  10K  [0201]  267.97,100.03 0 top
R39964  10K  [0201]  267.97,100.63 0 top
R39965  10K  [0201]  267.97,101.24 0 top
R39966  10K  [0201]  267.97,101.85 0 top
R39967  10K  [0201]  267.97,102.46 0 top
R39968  10K  [0201]  267.97,103.07 0 top
R39969  10K  [0201]  267.97,103.68 0 top
R39970  10K  [0201]  267.97,104.29 0 top
R39971  10K  [0201]  267.97,104.9 0 top
R39972  10K  [0201]  267.97,105.51 0 top
R39973  10K  [0201]  267.97,106.12 0 top
R39974  10K  [0201]  267.97,106.73 0 top
R39975  10K  [0201]  267.97,107.34 0 top
R39976  10K  [0201]  267.97,107.95 0 top
R39977  10K  [0201]  267.97,108.56 0 top
R39978  10K  [0201]  267.97,109.17 0 top
R39979  10K  [0201]  267.97,109.78 0 top
R39980  10K  [0201]  267.97,110.39 0 top
R39981  10K  [0201]  267.97,111 0 top
R39982  10K  [0201]  267.97,111.61 0 top
R39983  10K  [0201]  267.97,112.22 0 top
R39984  10K  [0201]  267.97,112.83 0 top
R39985  10K  [0201]  267.97,113.44 0 top
R39986  10K  [0201]  267.97,114.05 0 top
R39987  10K  [0201]  267.97,114.66 0 top
R39988  10K  [0201]  267.97,115.27 0 top
R39989  10K  [0201]  267.97,115.87 0 top
R39990  10K  [0201]  267.97,116.48 0 top
R39991  10K  [0201]  267.97,117.09 0 top
R39992  10K  [0201]  267.97,117.7 0 top
R39993  10K  [0201]  267.97,118.31 0 top
R39994  10K  [0201]  267.97,118.92 0 top
R39995  10K  [0201]  267.97,119.53 0 top
R39996  10K  [0201]  267.97,120.14 0 top
R39997  10K  [0201]  267.97,120.75 0 top
R39998  10K  [0201]  267.97,121.36 0 top
R39999  10K  [0201]  267.97,121.97 0 top
R40000  10K  [0201]  267.97,122.58 0 top
U$1  [MOUNT_HOLE_150MIL]  7.62,7.62 0 top
U$2  [MOUNT_HOLE_150MIL]  7.62,116.23 0 top
U$3  [MOUNT_HOLE_150MIL]  285.7,7.62 0 top
U$4  [MOUNT_HOLE_150MIL]  285.7,116.23 0 top

## Tracks (layer width: path | path; a pad name or v marks a point on that pad's centre or on a via)
N$1
  pour Bottom: 1.22,1.27 292.05,1.27 292.05,122.58 1.22,122.58
N$2
  pour Top: 26.89,1.27 27.46,1.27 27.46,122.58 26.89,122.58
N$4
  pour Top: 28.11,1.27 28.68,1.27 28.68,122.58 28.11,122.58
N$5
  pour Top: 29.33,1.27 29.9,1.27 29.9,122.58 29.33,122.58
N$7
  pour Top: 1.27,1.27 25.02,1.27 25.02,122.58 1.27,122.58
N$8
  pour Top: 25.67,1.27 26.24,1.27 26.24,122.58 25.67,122.58
N$9
  pour Top: 30.55,1.27 31.12,1.27 31.12,122.58 30.55,122.58
N$10
  pour Top: 31.77,1.27 32.34,1.27 32.34,122.58 31.77,122.58
N$11
  pour Top: 32.99,1.27 33.56,1.27 33.56,122.58 32.99,122.58
N$12
  pour Top: 34.21,1.27 34.78,1.27 34.78,122.58 34.21,122.58
N$14
  pour Top: 35.43,1.27 36,1.27 36,122.58 35.43,122.58
N$15
  pour Top: 36.65,1.27 37.22,1.27 37.22,122.58 36.65,122.58
N$16
  pour Top: 37.87,1.27 38.44,1.27 38.44,122.58 37.87,122.58
N$17
  pour Top: 39.09,1.27 39.65,1.27 39.65,122.58 39.09,122.58
N$18
  pour Top: 40.3,1.27 40.87,1.27 40.87,122.58 40.3,122.58
N$19
  pour Top: 41.52,1.27 42.09,1.27 42.09,122.58 41.52,122.58
N$20
  pour Top: 42.74,1.27 43.31,1.27 43.31,122.58 42.74,122.58
N$21
  pour Top: 43.96,1.27 44.53,1.27 44.53,122.58 43.96,122.58
N$23
  pour Top: 45.18,1.27 45.75,1.27 45.75,122.58 45.18,122.58
N$24
  pour Top: 46.4,1.27 46.97,1.27 46.97,122.58 46.4,122.58
N$25
  pour Top: 47.62,1.27 48.19,1.27 48.19,122.58 47.62,122.58
N$26
  pour Top: 48.84,1.27 49.41,1.27 49.41,122.58 48.84,122.58
N$27
  pour Top: 50.06,1.27 50.63,1.27 50.63,122.58 50.06,122.58
N$28
  pour Top: 51.28,1.27 51.85,1.27 51.85,122.58 51.28,122.58
N$29
  pour Top: 52.5,1.27 53.07,1.27 53.07,122.58 52.5,122.58
N$30
  pour Top: 53.72,1.27 54.28,1.27 54.28,122.58 53.72,122.58
N$31
  pour Top: 54.94,1.27 55.5,1.27 55.5,122.58 54.94,122.58
N$32
  pour Top: 56.15,1.27 56.72,1.27 56.72,122.58 56.15,122.58
N$33
  pour Top: 57.37,1.27 57.94,1.27 57.94,122.58 57.37,122.58
N$34
  pour Top: 58.59,1.27 59.16,1.27 59.16,122.58 58.59,122.58
N$35
  pour Top: 59.81,1.27 60.38,1.27 60.38,122.58 59.81,122.58
N$36
  pour Top: 61.03,1.27 61.6,1.27 61.6,122.58 61.03,122.58
N$37
  pour Top: 62.25,1.27 62.82,1.27 62.82,122.58 62.25,122.58
N$38
  pour Top: 63.47,1.27 64.04,1.27 64.04,122.58 63.47,122.58
N$40
  pour Top: 64.69,1.27 65.26,1.27 65.26,122.58 64.69,122.58
N$41
  pour Top: 65.91,1.27 66.48,1.27 66.48,122.58 65.91,122.58
N$42
  pour Top: 67.13,1.27 67.7,1.27 67.7,122.58 67.13,122.58
N$43
  pour Top: 68.35,1.27 68.92,1.27 68.92,122.58 68.35,122.58
N$44
  pour Top: 69.57,1.27 70.13,1.27 70.13,122.58 69.57,122.58
N$45
  pour Top: 70.78,1.27 71.35,1.27 71.35,122.58 70.78,122.58
N$46
  pour Top: 72,1.27 72.57,1.27 72.57,122.58 72,122.58
N$47
  pour Top: 73.22,1.27 73.79,1.27 73.79,122.58 73.22,122.58
N$48
  pour Top: 74.44,1.27 75.01,1.27 75.01,122.58 74.44,122.58
N$49
  pour Top: 75.66,1.27 76.23,1.27 76.23,122.58 75.66,122.58
N$50
  pour Top: 76.88,1.27 77.45,1.27 77.45,122.58 76.88,122.58
N$51
  pour Top: 78.1,1.27 78.67,1.27 78.67,122.58 78.1,122.58
N$52
  pour Top: 79.32,1.27 79.89,1.27 79.89,122.58 79.32,122.58
N$53
  pour Top: 80.54,1.27 81.11,1.27 81.11,122.58 80.54,122.58
N$54
  pour Top: 81.76,1.27 82.33,1.27 82.33,122.58 81.76,122.58
N$55
  pour Top: 82.98,1.27 83.55,1.27 83.55,122.58 82.98,122.58
N$56
  pour Top: 84.2,1.27 84.77,1.27 84.77,122.58 84.2,122.58
N$57
  pour Top: 85.42,1.27 85.98,1.27 85.98,122.58 85.42,122.58
N$58
  pour Top: 86.63,1.27 87.2,1.27 87.2,122.58 86.63,122.58
N$59
  pour Top: 87.85,1.27 88.42,1.27 88.42,122.58 87.85,122.58
N$60
  pour Top: 89.07,1.27 89.64,1.27 89.64,122.58 89.07,122.58
N$61
  pour Top: 90.29,1.27 90.86,1.27 90.86,122.58 90.29,122.58
N$62
  pour Top: 91.51,1.27 92.08,1.27 92.08,122.58 91.51,122.58
N$63
  pour Top: 92.73,1.27 93.3,1.27 93.3,122.58 92.73,122.58
N$64
  pour Top: 93.95,1.27 94.52,1.27 94.52,122.58 93.95,122.58
N$65
  pour Top: 95.17,1.27 95.74,1.27 95.74,122.58 95.17,122.58
N$66
  pour Top: 96.39,1.27 96.96,1.27 96.96,122.58 96.39,122.58
N$67
  pour Top: 97.61,1.27 98.18,1.27 98.18,122.58 97.61,122.58
N$68
  pour Top: 98.83,1.27 99.4,1.27 99.4,122.58 98.83,122.58
N$69
  pour Top: 100.05,1.27 100.61,1.27 100.61,122.58 100.05,122.58
N$70
  pour Top: 101.26,1.27 101.83,1.27 101.83,122.58 101.26,122.58
N$71
  pour Top: 102.48,1.27 103.05,1.27 103.05,122.58 102.48,122.58
N$73
  pour Top: 103.7,1.27 104.27,1.27 104.27,122.58 103.7,122.58
N$74
  pour Top: 104.92,1.27 105.49,1.27 105.49,122.58 104.92,122.58
N$75
  pour Top: 106.14,1.27 106.71,1.27 106.71,122.58 106.14,122.58
N$76
  pour Top: 107.36,1.27 107.93,1.27 107.93,122.58 107.36,122.58
N$77
  pour Top: 108.58,1.27 109.15,1.27 109.15,122.58 108.58,122.58
N$78
  pour Top: 109.8,1.27 110.37,1.27 110.37,122.58 109.8,122.58
N$79
  pour Top: 111.02,1.27 111.59,1.27 111.59,122.58 111.02,122.58
N$80
  pour Top: 112.24,1.27 112.81,1.27 112.81,122.58 112.24,122.58
N$81
  pour Top: 113.46,1.27 114.03,1.27 114.03,122.58 113.46,122.58
N$82
  pour Top: 114.68,1.27 115.24,1.27 115.24,122.58 114.68,122.58
N$83
  pour Top: 115.89,1.27 116.46,1.27 116.46,122.58 115.89,122.58
N$84
  pour Top: 117.11,1.27 117.68,1.27 117.68,122.58 117.11,122.58
N$85
  pour Top: 118.33,1.27 118.9,1.27 118.9,122.58 118.33,122.58
N$86
  pour Top: 119.55,1.27 120.12,1.27 120.12,122.58 119.55,122.58
N$87
  pour Top: 120.77,1.27 121.34,1.27 121.34,122.58 120.77,122.58
N$88
  pour Top: 121.99,1.27 122.56,1.27 122.56,122.58 121.99,122.58
N$89
  pour Top: 123.21,1.27 123.78,1.27 123.78,122.58 123.21,122.58
N$90
  pour Top: 124.43,1.27 125,1.27 125,122.58 124.43,122.58
N$91
  pour Top: 125.65,1.27 126.22,1.27 126.22,122.58 125.65,122.58
N$92
  pour Top: 126.87,1.27 127.44,1.27 127.44,122.58 126.87,122.58
N$93
  pour Top: 128.09,1.27 128.66,1.27 128.66,122.58 128.09,122.58
N$94
  pour Top: 129.31,1.27 129.88,1.27 129.88,122.58 129.31,122.58
N$95
  pour Top: 130.53,1.27 131.09,1.27 131.09,122.58 130.53,122.58
N$96
  pour Top: 131.74,1.27 132.31,1.27 132.31,122.58 131.74,122.58
N$97
  pour Top: 132.96,1.27 133.53,1.27 133.53,122.58 132.96,122.58
N$98
  pour Top: 134.18,1.27 134.75,1.27 134.75,122.58 134.18,122.58
N$99
  pour Top: 135.4,1.27 135.97,1.27 135.97,122.58 135.4,122.58
N$100
  pour Top: 136.62,1.27 137.19,1.27 137.19,122.58 136.62,122.58
N$101
  pour Top: 137.84,1.27 138.41,1.27 138.41,122.58 137.84,122.58
N$102
  pour Top: 139.06,1.27 139.63,1.27 139.63,122.58 139.06,122.58
N$103
  pour Top: 140.28,1.27 140.85,1.27 140.85,122.58 140.28,122.58
N$104
  pour Top: 141.5,1.27 142.07,1.27 142.07,122.58 141.5,122.58
N$105
  pour Top: 142.72,1.27 143.29,1.27 143.29,122.58 142.72,122.58
N$106
  pour Top: 143.94,1.27 144.51,1.27 144.51,122.58 143.94,122.58
N$107
  pour Top: 145.16,1.27 145.72,1.27 145.72,122.58 145.16,122.58
N$108
  pour Top: 146.38,1.27 146.94,1.27 146.94,122.58 146.38,122.58
N$109
  pour Top: 147.59,1.27 148.16,1.27 148.16,122.58 147.59,122.58
N$110
  pour Top: 148.81,1.27 149.38,1.27 149.38,122.58 148.81,122.58
N$111
  pour Top: 150.03,1.27 150.6,1.27 150.6,122.58 150.03,122.58
N$112
  pour Top: 151.25,1.27 151.82,1.27 151.82,122.58 151.25,122.58
N$113
  pour Top: 152.47,1.27 153.04,1.27 153.04,122.58 152.47,122.58
N$114
  pour Top: 153.69,1.27 154.26,1.27 154.26,122.58 153.69,122.58
N$115
  pour Top: 154.91,1.27 155.48,1.27 155.48,122.58 154.91,122.58
N$116
  pour Top: 156.13,1.27 156.7,1.27 156.7,122.58 156.13,122.58
N$117
  pour Top: 157.35,1.27 157.92,1.27 157.92,122.58 157.35,122.58
N$118
  pour Top: 158.57,1.27 159.14,1.27 159.14,122.58 158.57,122.58
N$119
  pour Top: 159.79,1.27 160.36,1.27 160.36,122.58 159.79,122.58
N$120
  pour Top: 161.01,1.27 161.57,1.27 161.57,122.58 161.01,122.58
N$121
  pour Top: 162.22,1.27 162.79,1.27 162.79,122.58 162.22,122.58
N$122
  pour Top: 163.44,1.27 164.01,1.27 164.01,122.58 163.44,122.58
N$123
  pour Top: 164.66,1.27 165.23,1.27 165.23,122.58 164.66,122.58
N$124
  pour Top: 165.88,1.27 166.45,1.27 166.45,122.58 165.88,122.58
N$125
  pour Top: 167.1,1.27 167.67,1.27 167.67,122.58 167.1,122.58
N$126
  pour Top: 168.32,1.27 168.89,1.27 168.89,122.58 168.32,122.58
N$127
  pour Top: 169.54,1.27 170.11,1.27 170.11,122.58 169.54,122.58
N$128
  pour Top: 170.76,1.27 171.33,1.27 171.33,122.58 170.76,122.58
N$129
  pour Top: 171.98,1.27 172.55,1.27 172.55,122.58 171.98,122.58
N$130
  pour Top: 173.2,1.27 173.77,1.27 173.77,122.58 173.2,122.58
N$131
  pour Top: 174.42,1.27 174.99,1.27 174.99,122.58 174.42,122.58
N$132
  pour Top: 175.64,1.27 176.2,1.27 176.2,122.58 175.64,122.58
N$133
  pour Top: 176.85,1.27 177.42,1.27 177.42,122.58 176.85,122.58
N$134
  pour Top: 178.07,1.27 178.64,1.27 178.64,122.58 178.07,122.58
N$135
  pour Top: 179.29,1.27 179.86,1.27 179.86,122.58 179.29,122.58
N$136
  pour Top: 180.51,1.27 181.08,1.27 181.08,122.58 180.51,122.58
N$138
  pour Top: 181.73,1.27 182.3,1.27 182.3,122.58 181.73,122.58
N$139
  pour Top: 182.95,1.27 183.52,1.27 183.52,122.58 182.95,122.58
N$140
  pour Top: 184.17,1.27 184.74,1.27 184.74,122.58 184.17,122.58
N$141
  pour Top: 185.39,1.27 185.96,1.27 185.96,122.58 185.39,122.58
N$142
  pour Top: 186.61,1.27 187.18,1.27 187.18,122.58 186.61,122.58
N$143
  pour Top: 187.83,1.27 188.4,1.27 188.4,122.58 187.83,122.58
N$144
  pour Top: 189.05,1.27 189.62,1.27 189.62,122.58 189.05,122.58
N$145
  pour Top: 190.27,1.27 190.84,1.27 190.84,122.58 190.27,122.58
N$146
  pour Top: 191.49,1.27 192.05,1.27 192.05,122.58 191.49,122.58
N$147
  pour Top: 192.7,1.27 193.27,1.27 193.27,122.58 192.7,122.58
N$148
  pour Top: 193.92,1.27 194.49,1.27 194.49,122.58 193.92,122.58
N$149
  pour Top: 195.14,1.27 195.71,1.27 195.71,122.58 195.14,122.58
N$150
  pour Top: 196.36,1.27 196.93,1.27 196.93,122.58 196.36,122.58
N$151
  pour Top: 197.58,1.27 198.15,1.27 198.15,122.58 197.58,122.58
N$152
  pour Top: 198.8,1.27 199.37,1.27 199.37,122.58 198.8,122.58
N$153
  pour Top: 200.02,1.27 200.59,1.27 200.59,122.58 200.02,122.58
N$154
  pour Top: 201.24,1.27 201.81,1.27 201.81,122.58 201.24,122.58
N$155
  pour Top: 202.46,1.27 203.03,1.27 203.03,122.58 202.46,122.58
N$156
  pour Top: 203.68,1.27 204.25,1.27 204.25,122.58 203.68,122.58
N$157
  pour Top: 204.9,1.27 205.47,1.27 205.47,122.58 204.9,122.58
N$158
  pour Top: 206.12,1.27 206.69,1.27 206.69,122.58 206.12,122.58
N$159
  pour Top: 207.34,1.27 207.9,1.27 207.9,122.58 207.34,122.58
N$160
  pour Top: 208.55,1.27 209.12,1.27 209.12,122.58 208.55,122.58
N$161
  pour Top: 209.77,1.27 210.34,1.27 210.34,122.58 209.77,122.58
N$162
  pour Top: 210.99,1.27 211.56,1.27 211.56,122.58 210.99,122.58
N$163
  pour Top: 212.21,1.27 212.78,1.27 212.78,122.58 212.21,122.58
N$164
  pour Top: 213.43,1.27 214,1.27 214,122.58 213.43,122.58
N$165
  pour Top: 214.65,1.27 215.22,1.27 215.22,122.58 214.65,122.58
N$166
  pour Top: 215.87,1.27 216.44,1.27 216.44,122.58 215.87,122.58
N$167
  pour Top: 217.09,1.27 217.66,1.27 217.66,122.58 217.09,122.58
N$168
  pour Top: 218.31,1.27 218.88,1.27 218.88,122.58 218.31,122.58
N$169
  pour Top: 219.53,1.27 220.1,1.27 220.1,122.58 219.53,122.58
N$170
  pour Top: 220.75,1.27 221.32,1.27 221.32,122.58 220.75,122.58
N$171
  pour Top: 221.97,1.27 222.53,1.27 222.53,122.58 221.97,122.58
N$172
  pour Top: 223.18,1.27 223.75,1.27 223.75,122.58 223.18,122.58
N$173
  pour Top: 224.4,1.27 224.97,1.27 224.97,122.58 224.4,122.58
N$174
  pour Top: 225.62,1.27 226.19,1.27 226.19,122.58 225.62,122.58
N$175
  pour Top: 226.84,1.27 227.41,1.27 227.41,122.58 226.84,122.58
N$176
  pour Top: 228.06,1.27 228.63,1.27 228.63,122.58 228.06,122.58
N$177
  pour Top: 229.28,1.27 229.85,1.27 229.85,122.58 229.28,122.58
N$178
  pour Top: 230.5,1.27 231.07,1.27 231.07,122.58 230.5,122.58
N$179
  pour Top: 231.72,1.27 232.29,1.27 232.29,122.58 231.72,122.58
N$180
  pour Top: 232.94,1.27 233.51,1.27 233.51,122.58 232.94,122.58
N$181
  pour Top: 234.16,1.27 234.73,1.27 234.73,122.58 234.16,122.58
N$182
  pour Top: 235.38,1.27 235.95,1.27 235.95,122.58 235.38,122.58
N$183
  pour Top: 236.6,1.27 237.16,1.27 237.16,122.58 236.6,122.58
N$184
  pour Top: 237.81,1.27 238.38,1.27 238.38,122.58 237.81,122.58
N$185
  pour Top: 239.03,1.27 239.6,1.27 239.6,122.58 239.03,122.58
N$186
  pour Top: 240.25,1.27 240.82,1.27 240.82,122.58 240.25,122.58
N$187
  pour Top: 241.47,1.27 242.04,1.27 242.04,122.58 241.47,122.58
N$188
  pour Top: 242.69,1.27 243.26,1.27 243.26,122.58 242.69,122.58
N$189
  pour Top: 243.91,1.27 244.48,1.27 244.48,122.58 243.91,122.58
N$190
  pour Top: 245.13,1.27 245.7,1.27 245.7,122.58 245.13,122.58
N$191
  pour Top: 246.35,1.27 246.92,1.27 246.92,122.58 246.35,122.58
N$192
  pour Top: 247.57,1.27 248.14,1.27 248.14,122.58 247.57,122.58
N$193
  pour Top: 248.79,1.27 249.36,1.27 249.36,122.58 248.79,122.58
N$194
  pour Top: 250.01,1.27 250.58,1.27 250.58,122.58 250.01,122.58
N$195
  pour Top: 251.23,1.27 251.8,1.27 251.8,122.58 251.23,122.58
N$196
  pour Top: 252.45,1.27 253.01,1.27 253.01,122.58 252.45,122.58
N$197
  pour Top: 253.66,1.27 254.23,1.27 254.23,122.58 253.66,122.58
N$198
  pour Top: 254.88,1.27 255.45,1.27 255.45,122.58 254.88,122.58
N$199
  pour Top: 256.1,1.27 256.67,1.27 256.67,122.58 256.1,122.58
N$200
  pour Top: 257.32,1.27 257.89,1.27 257.89,122.58 257.32,122.58
N$201
  pour Top: 258.54,1.27 259.11,1.27 259.11,122.58 258.54,122.58
N$202
  pour Top: 259.76,1.27 260.33,1.27 260.33,122.58 259.76,122.58
N$203
  pour Top: 260.98,1.27 261.55,1.27 261.55,122.58 260.98,122.58
N$204
  pour Top: 262.2,1.27 262.77,1.27 262.77,122.58 262.2,122.58
N$205
  pour Top: 263.42,1.27 263.99,1.27 263.99,122.58 263.42,122.58
N$206
  pour Top: 264.64,1.27 265.21,1.27 265.21,122.58 264.64,122.58
N$207
  pour Top: 265.86,1.27 266.43,1.27 266.43,122.58 265.86,122.58
N$208
  pour Top: 267.08,1.27 267.65,1.27 267.65,122.58 267.08,122.58
N$209
  pour Top: 268.3,1.27 292.05,1.27 292.05,122.58 268.3,122.58